# EAGLE board Resistor_Resistor (EAGLE 8.3.0), part 14 of 32
## Placement (x,y rotation side) (continued)
R16746  10K  [0201]  126.54,89.66 0 top
R16747  10K  [0201]  126.54,90.27 0 top
R16748  10K  [0201]  126.54,90.88 0 top
R16749  10K  [0201]  126.54,91.49 0 top
R16750  10K  [0201]  126.54,92.1 0 top
R16751  10K  [0201]  126.54,92.71 0 top
R16752  10K  [0201]  126.54,93.32 0 top
R16753  10K  [0201]  126.54,93.93 0 top
R16754  10K  [0201]  126.54,94.54 0 top
R16755  10K  [0201]  126.54,95.15 0 top
R16756  10K  [0201]  126.54,95.76 0 top
R16757  10K  [0201]  126.54,96.37 0 top
R16758  10K  [0201]  126.54,96.98 0 top
R16759  10K  [0201]  126.54,97.59 0 top
R16760  10K  [0201]  126.54,98.2 0 top
R16761  10K  [0201]  126.54,98.81 0 top
R16762  10K  [0201]  126.54,99.42 0 top
R16763  10K  [0201]  126.54,100.03 0 top
R16764  10K  [0201]  126.54,100.63 0 top
R16765  10K  [0201]  126.54,101.24 0 top
R16766  10K  [0201]  126.54,101.85 0 top
R16767  10K  [0201]  126.54,102.46 0 top
R16768  10K  [0201]  126.54,103.07 0 top
R16769  10K  [0201]  126.54,103.68 0 top
R16770  10K  [0201]  126.54,104.29 0 top
R16771  10K  [0201]  126.54,104.9 0 top
R16772  10K  [0201]  126.54,105.51 0 top
R16773  10K  [0201]  126.54,106.12 0 top
R16774  10K  [0201]  126.54,106.73 0 top
R16775  10K  [0201]  126.54,107.34 0 top
R16776  10K  [0201]  126.54,107.95 0 top
R16777  10K  [0201]  126.54,108.56 0 top
R16778  10K  [0201]  126.54,109.17 0 top
R16779  10K  [0201]  126.54,109.78 0 top
R16780  10K  [0201]  126.54,110.39 0 top
R16781  10K  [0201]  126.54,111 0 top
R16782  10K  [0201]  126.54,111.61 0 top
R16783  10K  [0201]  126.54,112.22 0 top
R16784  10K  [0201]  126.54,112.83 0 top
R16785  10K  [0201]  126.54,113.44 0 top
R16786  10K  [0201]  126.54,114.05 0 top
R16787  10K  [0201]  126.54,114.66 0 top
R16788  10K  [0201]  126.54,115.27 0 top
R16789  10K  [0201]  126.54,115.87 0 top
R16790  10K  [0201]  126.54,116.48 0 top
R16791  10K  [0201]  126.54,117.09 0 top
R16792  10K  [0201]  126.54,117.7 0 top
R16793  10K  [0201]  126.54,118.31 0 top
R16794  10K  [0201]  126.54,118.92 0 top
R16795  10K  [0201]  126.54,119.53 0 top
R16796  10K  [0201]  126.54,120.14 0 top
R16797  10K  [0201]  126.54,120.75 0 top
R16798  10K  [0201]  126.54,121.36 0 top
R16799  10K  [0201]  126.54,121.97 0 top
R16800  10K  [0201]  126.54,122.58 0 top
R16801  10K  [0201]  127.76,1.27 0 top
R16802  10K  [0201]  127.76,1.88 0 top
R16803  10K  [0201]  127.76,2.49 0 top
R16804  10K  [0201]  127.76,3.1 0 top
R16805  10K  [0201]  127.76,3.71 0 top
R16806  10K  [0201]  127.76,4.32 0 top
R16807  10K  [0201]  127.76,4.93 0 top
R16808  10K  [0201]  127.76,5.54 0 top
R16809  10K  [0201]  127.76,6.15 0 top
R16810  10K  [0201]  127.76,6.76 0 top
R16811  10K  [0201]  127.76,7.37 0 top
R16812  10K  [0201]  127.76,7.98 0 top
R16813  10K  [0201]  127.76,8.59 0 top
R16814  10K  [0201]  127.76,9.19 0 top
R16815  10K  [0201]  127.76,9.8 0 top
R16816  10K  [0201]  127.76,10.41 0 top
R16817  10K  [0201]  127.76,11.02 0 top
R16818  10K  [0201]  127.76,11.63 0 top
R16819  10K  [0201]  127.76,12.24 0 top
R16820  10K  [0201]  127.76,12.85 0 top
R16821  10K  [0201]  127.76,13.46 0 top
R16822  10K  [0201]  127.76,14.07 0 top
R16823  10K  [0201]  127.76,14.68 0 top
R16824  10K  [0201]  127.76,15.29 0 top
R16825  10K  [0201]  127.76,15.9 0 top
R16826  10K  [0201]  127.76,16.51 0 top
R16827  10K  [0201]  127.76,17.12 0 top
R16828  10K  [0201]  127.76,17.73 0 top
R16829  10K  [0201]  127.76,18.34 0 top
R16830  10K  [0201]  127.76,18.95 0 top
R16831  10K  [0201]  127.76,19.56 0 top
R16832  10K  [0201]  127.76,20.17 0 top
R16833  10K  [0201]  127.76,20.78 0 top
R16834  10K  [0201]  127.76,21.39 0 top
R16835  10K  [0201]  127.76,22 0 top
R16836  10K  [0201]  127.76,22.61 0 top
R16837  10K  [0201]  127.76,23.22 0 top
R16838  10K  [0201]  127.76,23.83 0 top
R16839  10K  [0201]  127.76,24.43 0 top
R16840  10K  [0201]  127.76,25.04 0 top
R16841  10K  [0201]  127.76,25.65 0 top
R16842  10K  [0201]  127.76,26.26 0 top
R16843  10K  [0201]  127.76,26.87 0 top
R16844  10K  [0201]  127.76,27.48 0 top
R16845  10K  [0201]  127.76,28.09 0 top
R16846  10K  [0201]  127.76,28.7 0 top
R16847  10K  [0201]  127.76,29.31 0 top
R16848  10K  [0201]  127.76,29.92 0 top
R16849  10K  [0201]  127.76,30.53 0 top
R16850  10K  [0201]  127.76,31.14 0 top
R16851  10K  [0201]  127.76,31.75 0 top
R16852  10K  [0201]  127.76,32.36 0 top
R16853  10K  [0201]  127.76,32.97 0 top
R16854  10K  [0201]  127.76,33.58 0 top
R16855  10K  [0201]  127.76,34.19 0 top
R16856  10K  [0201]  127.76,34.8 0 top
R16857  10K  [0201]  127.76,35.41 0 top
R16858  10K  [0201]  127.76,36.02 0 top
R16859  10K  [0201]  127.76,36.63 0 top
R16860  10K  [0201]  127.76,37.24 0 top
R16861  10K  [0201]  127.76,37.85 0 top
R16862  10K  [0201]  127.76,38.46 0 top
R16863  10K  [0201]  127.76,39.07 0 top
R16864  10K  [0201]  127.76,39.67 0 top
R16865  10K  [0201]  127.76,40.28 0 top
R16866  10K  [0201]  127.76,40.89 0 top
R16867  10K  [0201]  127.76,41.5 0 top
R16868  10K  [0201]  127.76,42.11 0 top
R16869  10K  [0201]  127.76,42.72 0 top
R16870  10K  [0201]  127.76,43.33 0 top
R16871  10K  [0201]  127.76,43.94 0 top
R16872  10K  [0201]  127.76,44.55 0 top
R16873  10K  [0201]  127.76,45.16 0 top
R16874  10K  [0201]  127.76,45.77 0 top
R16875  10K  [0201]  127.76,46.38 0 top
R16876  10K  [0201]  127.76,46.99 0 top
R16877  10K  [0201]  127.76,47.6 0 top
R16878  10K  [0201]  127.76,48.21 0 top
R16879  10K  [0201]  127.76,48.82 0 top
R16880  10K  [0201]  127.76,49.43 0 top
R16881  10K  [0201]  127.76,50.04 0 top
R16882  10K  [0201]  127.76,50.65 0 top
R16883  10K  [0201]  127.76,51.26 0 top
R16884  10K  [0201]  127.76,51.87 0 top
R16885  10K  [0201]  127.76,52.48 0 top
R16886  10K  [0201]  127.76,53.09 0 top
R16887  10K  [0201]  127.76,53.7 0 top
R16888  10K  [0201]  127.76,54.31 0 top
R16889  10K  [0201]  127.76,54.91 0 top
R16890  10K  [0201]  127.76,55.52 0 top
R16891  10K  [0201]  127.76,56.13 0 top
R16892  10K  [0201]  127.76,56.74 0 top
R16893  10K  [0201]  127.76,57.35 0 top
R16894  10K  [0201]  127.76,57.96 0 top
R16895  10K  [0201]  127.76,58.57 0 top
R16896  10K  [0201]  127.76,59.18 0 top
R16897  10K  [0201]  127.76,59.79 0 top
R16898  10K  [0201]  127.76,60.4 0 top
R16899  10K  [0201]  127.76,61.01 0 top
R16900  10K  [0201]  127.76,61.62 0 top
R16901  10K  [0201]  127.76,62.23 0 top
R16902  10K  [0201]  127.76,62.84 0 top
R16903  10K  [0201]  127.76,63.45 0 top
R16904  10K  [0201]  127.76,64.06 0 top
R16905  10K  [0201]  127.76,64.67 0 top
R16906  10K  [0201]  127.76,65.28 0 top
R16907  10K  [0201]  127.76,65.89 0 top
R16908  10K  [0201]  127.76,66.5 0 top
R16909  10K  [0201]  127.76,67.11 0 top
R16910  10K  [0201]  127.76,67.72 0 top
R16911  10K  [0201]  127.76,68.33 0 top
R16912  10K  [0201]  127.76,68.94 0 top
R16913  10K  [0201]  127.76,69.55 0 top
R16914  10K  [0201]  127.76,70.15 0 top
R16915  10K  [0201]  127.76,70.76 0 top
R16916  10K  [0201]  127.76,71.37 0 top
R16917  10K  [0201]  127.76,71.98 0 top
R16918  10K  [0201]  127.76,72.59 0 top
R16919  10K  [0201]  127.76,73.2 0 top
R16920  10K  [0201]  127.76,73.81 0 top
R16921  10K  [0201]  127.76,74.42 0 top
R16922  10K  [0201]  127.76,75.03 0 top
R16923  10K  [0201]  127.76,75.64 0 top
R16924  10K  [0201]  127.76,76.25 0 top
R16925  10K  [0201]  127.76,76.86 0 top
R16926  10K  [0201]  127.76,77.47 0 top
R16927  10K  [0201]  127.76,78.08 0 top
R16928  10K  [0201]  127.76,78.69 0 top
R16929  10K  [0201]  127.76,79.3 0 top
R16930  10K  [0201]  127.76,79.91 0 top
R16931  10K  [0201]  127.76,80.52 0 top
R16932  10K  [0201]  127.76,81.13 0 top
R16933  10K  [0201]  127.76,81.74 0 top
R16934  10K  [0201]  127.76,82.35 0 top
R16935  10K  [0201]  127.76,82.96 0 top
R16936  10K  [0201]  127.76,83.57 0 top
R16937  10K  [0201]  127.76,84.18 0 top
R16938  10K  [0201]  127.76,84.79 0 top
R16939  10K  [0201]  127.76,85.39 0 top
R16940  10K  [0201]  127.76,86 0 top
R16941  10K  [0201]  127.76,86.61 0 top
R16942  10K  [0201]  127.76,87.22 0 top
R16943  10K  [0201]  127.76,87.83 0 top
R16944  10K  [0201]  127.76,88.44 0 top
R16945  10K  [0201]  127.76,89.05 0 top
R16946  10K  [0201]  127.76,89.66 0 top
R16947  10K  [0201]  127.76,90.27 0 top
R16948  10K  [0201]  127.76,90.88 0 top
R16949  10K  [0201]  127.76,91.49 0 top
R16950  10K  [0201]  127.76,92.1 0 top
R16951  10K  [0201]  127.76,92.71 0 top
R16952  10K  [0201]  127.76,93.32 0 top
R16953  10K  [0201]  127.76,93.93 0 top
R16954  10K  [0201]  127.76,94.54 0 top
R16955  10K  [0201]  127.76,95.15 0 top
R16956  10K  [0201]  127.76,95.76 0 top
R16957  10K  [0201]  127.76,96.37 0 top
R16958  10K  [0201]  127.76,96.98 0 top
R16959  10K  [0201]  127.76,97.59 0 top
R16960  10K  [0201]  127.76,98.2 0 top
R16961  10K  [0201]  127.76,98.81 0 top
R16962  10K  [0201]  127.76,99.42 0 top
R16963  10K  [0201]  127.76,100.03 0 top
R16964  10K  [0201]  127.76,100.63 0 top
R16965  10K  [0201]  127.76,101.24 0 top
R16966  10K  [0201]  127.76,101.85 0 top
R16967  10K  [0201]  127.76,102.46 0 top
R16968  10K  [0201]  127.76,103.07 0 top
R16969  10K  [0201]  127.76,103.68 0 top
R16970  10K  [0201]  127.76,104.29 0 top
R16971  10K  [0201]  127.76,104.9 0 top
R16972  10K  [0201]  127.76,105.51 0 top
R16973  10K  [0201]  127.76,106.12 0 top
R16974  10K  [0201]  127.76,106.73 0 top
R16975  10K  [0201]  127.76,107.34 0 top
R16976  10K  [0201]  127.76,107.95 0 top
R16977  10K  [0201]  127.76,108.56 0 top
R16978  10K  [0201]  127.76,109.17 0 top
R16979  10K  [0201]  127.76,109.78 0 top
R16980  10K  [0201]  127.76,110.39 0 top
R16981  10K  [0201]  127.76,111 0 top
R16982  10K  [0201]  127.76,111.61 0 top
R16983  10K  [0201]  127.76,112.22 0 top
R16984  10K  [0201]  127.76,112.83 0 top
R16985  10K  [0201]  127.76,113.44 0 top
R16986  10K  [0201]  127.76,114.05 0 top
R16987  10K  [0201]  127.76,114.66 0 top
R16988  10K  [0201]  127.76,115.27 0 top
R16989  10K  [0201]  127.76,115.87 0 top
R16990  10K  [0201]  127.76,116.48 0 top
R16991  10K  [0201]  127.76,117.09 0 top
R16992  10K  [0201]  127.76,117.7 0 top
R16993  10K  [0201]  127.76,118.31 0 top
R16994  10K  [0201]  127.76,118.92 0 top
R16995  10K  [0201]  127.76,119.53 0 top
R16996  10K  [0201]  127.76,120.14 0 top
R16997  10K  [0201]  127.76,120.75 0 top
R16998  10K  [0201]  127.76,121.36 0 top
R16999  10K  [0201]  127.76,121.97 0 top
R17000  10K  [0201]  127.76,122.58 0 top
R17001  10K  [0201]  128.98,1.27 0 top
R17002  10K  [0201]  128.98,1.88 0 top
R17003  10K  [0201]  128.98,2.49 0 top
R17004  10K  [0201]  128.98,3.1 0 top
R17005  10K  [0201]  128.98,3.71 0 top
R17006  10K  [0201]  128.98,4.32 0 top
R17007  10K  [0201]  128.98,4.93 0 top
R17008  10K  [0201]  128.98,5.54 0 top
R17009  10K  [0201]  128.98,6.15 0 top
R17010  10K  [0201]  128.98,6.76 0 top
R17011  10K  [0201]  128.98,7.37 0 top
R17012  10K  [0201]  128.98,7.98 0 top
R17013  10K  [0201]  128.98,8.59 0 top
R17014  10K  [0201]  128.98,9.19 0 top
R17015  10K  [0201]  128.98,9.8 0 top
R17016  10K  [0201]  128.98,10.41 0 top
R17017  10K  [0201]  128.98,11.02 0 top
R17018  10K  [0201]  128.98,11.63 0 top
R17019  10K  [0201]  128.98,12.24 0 top
R17020  10K  [0201]  128.98,12.85 0 top
R17021  10K  [0201]  128.98,13.46 0 top
R17022  10K  [0201]  128.98,14.07 0 top
R17023  10K  [0201]  128.98,14.68 0 top
R17024  10K  [0201]  128.98,15.29 0 top
R17025  10K  [0201]  128.98,15.9 0 top
R17026  10K  [0201]  128.98,16.51 0 top
R17027  10K  [0201]  128.98,17.12 0 top
R17028  10K  [0201]  128.98,17.73 0 top
R17029  10K  [0201]  128.98,18.34 0 top
R17030  10K  [0201]  128.98,18.95 0 top
R17031  10K  [0201]  128.98,19.56 0 top
R17032  10K  [0201]  128.98,20.17 0 top
R17033  10K  [0201]  128.98,20.78 0 top
R17034  10K  [0201]  128.98,21.39 0 top
R17035  10K  [0201]  128.98,22 0 top
R17036  10K  [0201]  128.98,22.61 0 top
R17037  10K  [0201]  128.98,23.22 0 top
R17038  10K  [0201]  128.98,23.83 0 top
R17039  10K  [0201]  128.98,24.43 0 top
R17040  10K  [0201]  128.98,25.04 0 top
R17041  10K  [0201]  128.98,25.65 0 top
R17042  10K  [0201]  128.98,26.26 0 top
R17043  10K  [0201]  128.98,26.87 0 top
R17044  10K  [0201]  128.98,27.48 0 top
R17045  10K  [0201]  128.98,28.09 0 top
R17046  10K  [0201]  128.98,28.7 0 top
R17047  10K  [0201]  128.98,29.31 0 top
R17048  10K  [0201]  128.98,29.92 0 top
R17049  10K  [0201]  128.98,30.53 0 top
R17050  10K  [0201]  128.98,31.14 0 top
R17051  10K  [0201]  128.98,31.75 0 top
R17052  10K  [0201]  128.98,32.36 0 top
R17053  10K  [0201]  128.98,32.97 0 top
R17054  10K  [0201]  128.98,33.58 0 top
R17055  10K  [0201]  128.98,34.19 0 top
R17056  10K  [0201]  128.98,34.8 0 top
R17057  10K  [0201]  128.98,35.41 0 top
R17058  10K  [0201]  128.98,36.02 0 top
R17059  10K  [0201]  128.98,36.63 0 top
R17060  10K  [0201]  128.98,37.24 0 top
R17061  10K  [0201]  128.98,37.85 0 top
R17062  10K  [0201]  128.98,38.46 0 top
R17063  10K  [0201]  128.98,39.07 0 top
R17064  10K  [0201]  128.98,39.67 0 top
R17065  10K  [0201]  128.98,40.28 0 top
R17066  10K  [0201]  128.98,40.89 0 top
R17067  10K  [0201]  128.98,41.5 0 top
R17068  10K  [0201]  128.98,42.11 0 top
R17069  10K  [0201]  128.98,42.72 0 top
R17070  10K  [0201]  128.98,43.33 0 top
R17071  10K  [0201]  128.98,43.94 0 top
R17072  10K  [0201]  128.98,44.55 0 top
R17073  10K  [0201]  128.98,45.16 0 top
R17074  10K  [0201]  128.98,45.77 0 top
R17075  10K  [0201]  128.98,46.38 0 top
R17076  10K  [0201]  128.98,46.99 0 top
R17077  10K  [0201]  128.98,47.6 0 top
R17078  10K  [0201]  128.98,48.21 0 top
R17079  10K  [0201]  128.98,48.82 0 top
R17080  10K  [0201]  128.98,49.43 0 top
R17081  10K  [0201]  128.98,50.04 0 top
R17082  10K  [0201]  128.98,50.65 0 top
R17083  10K  [0201]  128.98,51.26 0 top
R17084  10K  [0201]  128.98,51.87 0 top
R17085  10K  [0201]  128.98,52.48 0 top
R17086  10K  [0201]  128.98,53.09 0 top
R17087  10K  [0201]  128.98,53.7 0 top
R17088  10K  [0201]  128.98,54.31 0 top
R17089  10K  [0201]  128.98,54.91 0 top
R17090  10K  [0201]  128.98,55.52 0 top
R17091  10K  [0201]  128.98,56.13 0 top
R17092  10K  [0201]  128.98,56.74 0 top
R17093  10K  [0201]  128.98,57.35 0 top
R17094  10K  [0201]  128.98,57.96 0 top
R17095  10K  [0201]  128.98,58.57 0 top
R17096  10K  [0201]  128.98,59.18 0 top
R17097  10K  [0201]  128.98,59.79 0 top
R17098  10K  [0201]  128.98,60.4 0 top
R17099  10K  [0201]  128.98,61.01 0 top
R17100  10K  [0201]  128.98,61.62 0 top
R17101  10K  [0201]  128.98,62.23 0 top
R17102  10K  [0201]  128.98,62.84 0 top
R17103  10K  [0201]  128.98,63.45 0 top
R17104  10K  [0201]  128.98,64.06 0 top
R17105  10K  [0201]  128.98,64.67 0 top
R17106  10K  [0201]  128.98,65.28 0 top
R17107  10K  [0201]  128.98,65.89 0 top
R17108  10K  [0201]  128.98,66.5 0 top
R17109  10K  [0201]  128.98,67.11 0 top
R17110  10K  [0201]  128.98,67.72 0 top
R17111  10K  [0201]  128.98,68.33 0 top
R17112  10K  [0201]  128.98,68.94 0 top
R17113  10K  [0201]  128.98,69.55 0 top
R17114  10K  [0201]  128.98,70.15 0 top
R17115  10K  [0201]  128.98,70.76 0 top
R17116  10K  [0201]  128.98,71.37 0 top
R17117  10K  [0201]  128.98,71.98 0 top
R17118  10K  [0201]  128.98,72.59 0 top
R17119  10K  [0201]  128.98,73.2 0 top
R17120  10K  [0201]  128.98,73.81 0 top
R17121  10K  [0201]  128.98,74.42 0 top
R17122  10K  [0201]  128.98,75.03 0 top
R17123  10K  [0201]  128.98,75.64 0 top
R17124  10K  [0201]  128.98,76.25 0 top
R17125  10K  [0201]  128.98,76.86 0 top
R17126  10K  [0201]  128.98,77.47 0 top
R17127  10K  [0201]  128.98,78.08 0 top
R17128  10K  [0201]  128.98,78.69 0 top
R17129  10K  [0201]  128.98,79.3 0 top
R17130  10K  [0201]  128.98,79.91 0 top
R17131  10K  [0201]  128.98,80.52 0 top
R17132  10K  [0201]  128.98,81.13 0 top
R17133  10K  [0201]  128.98,81.74 0 top
R17134  10K  [0201]  128.98,82.35 0 top
R17135  10K  [0201]  128.98,82.96 0 top
R17136  10K  [0201]  128.98,83.57 0 top
R17137  10K  [0201]  128.98,84.18 0 top
R17138  10K  [0201]  128.98,84.79 0 top
R17139  10K  [0201]  128.98,85.39 0 top
R17140  10K  [0201]  128.98,86 0 top
R17141  10K  [0201]  128.98,86.61 0 top
R17142  10K  [0201]  128.98,87.22 0 top
R17143  10K  [0201]  128.98,87.83 0 top
R17144  10K  [0201]  128.98,88.44 0 top
R17145  10K  [0201]  128.98,89.05 0 top
R17146  10K  [0201]  128.98,89.66 0 top
R17147  10K  [0201]  128.98,90.27 0 top
R17148  10K  [0201]  128.98,90.88 0 top
R17149  10K  [0201]  128.98,91.49 0 top
R17150  10K  [0201]  128.98,92.1 0 top
R17151  10K  [0201]  128.98,92.71 0 top
R17152  10K  [0201]  128.98,93.32 0 top
R17153  10K  [0201]  128.98,93.93 0 top
R17154  10K  [0201]  128.98,94.54 0 top
R17155  10K  [0201]  128.98,95.15 0 top
R17156  10K  [0201]  128.98,95.76 0 top
R17157  10K  [0201]  128.98,96.37 0 top
R17158  10K  [0201]  128.98,96.98 0 top
R17159  10K  [0201]  128.98,97.59 0 top
R17160  10K  [0201]  128.98,98.2 0 top
R17161  10K  [0201]  128.98,98.81 0 top
R17162  10K  [0201]  128.98,99.42 0 top
R17163  10K  [0201]  128.98,100.03 0 top
R17164  10K  [0201]  128.98,100.63 0 top
R17165  10K  [0201]  128.98,101.24 0 top
R17166  10K  [0201]  128.98,101.85 0 top
R17167  10K  [0201]  128.98,102.46 0 top
R17168  10K  [0201]  128.98,103.07 0 top
R17169  10K  [0201]  128.98,103.68 0 top
R17170  10K  [0201]  128.98,104.29 0 top
R17171  10K  [0201]  128.98,104.9 0 top
R17172  10K  [0201]  128.98,105.51 0 top
R17173  10K  [0201]  128.98,106.12 0 top
R17174  10K  [0201]  128.98,106.73 0 top
R17175  10K  [0201]  128.98,107.34 0 top
R17176  10K  [0201]  128.98,107.95 0 top
R17177  10K  [0201]  128.98,108.56 0 top
R17178  10K  [0201]  128.98,109.17 0 top
R17179  10K  [0201]  128.98,109.78 0 top
R17180  10K  [0201]  128.98,110.39 0 top
R17181  10K  [0201]  128.98,111 0 top
R17182  10K  [0201]  128.98,111.61 0 top
R17183  10K  [0201]  128.98,112.22 0 top
R17184  10K  [0201]  128.98,112.83 0 top
R17185  10K  [0201]  128.98,113.44 0 top
R17186  10K  [0201]  128.98,114.05 0 top
R17187  10K  [0201]  128.98,114.66 0 top
R17188  10K  [0201]  128.98,115.27 0 top
R17189  10K  [0201]  128.98,115.87 0 top
R17190  10K  [0201]  128.98,116.48 0 top
R17191  10K  [0201]  128.98,117.09 0 top
R17192  10K  [0201]  128.98,117.7 0 top
R17193  10K  [0201]  128.98,118.31 0 top
R17194  10K  [0201]  128.98,118.92 0 top
R17195  10K  [0201]  128.98,119.53 0 top
R17196  10K  [0201]  128.98,120.14 0 top
R17197  10K  [0201]  128.98,120.75 0 top
R17198  10K  [0201]  128.98,121.36 0 top
R17199  10K  [0201]  128.98,121.97 0 top
R17200  10K  [0201]  128.98,122.58 0 top
R17201  10K  [0201]  130.2,1.27 0 top
R17202  10K  [0201]  130.2,1.88 0 top
R17203  10K  [0201]  130.2,2.49 0 top
R17204  10K  [0201]  130.2,3.1 0 top
R17205  10K  [0201]  130.2,3.71 0 top
R17206  10K  [0201]  130.2,4.32 0 top
R17207  10K  [0201]  130.2,4.93 0 top
R17208  10K  [0201]  130.2,5.54 0 top
R17209  10K  [0201]  130.2,6.15 0 top
R17210  10K  [0201]  130.2,6.76 0 top
R17211  10K  [0201]  130.2,7.37 0 top
R17212  10K  [0201]  130.2,7.98 0 top
R17213  10K  [0201]  130.2,8.59 0 top
R17214  10K  [0201]  130.2,9.19 0 top
R17215  10K  [0201]  130.2,9.8 0 top
R17216  10K  [0201]  130.2,10.41 0 top
R17217  10K  [0201]  130.2,11.02 0 top
R17218  10K  [0201]  130.2,11.63 0 top
R17219  10K  [0201]  130.2,12.24 0 top
R17220  10K  [0201]  130.2,12.85 0 top
R17221  10K  [0201]  130.2,13.46 0 top
R17222  10K  [0201]  130.2,14.07 0 top
R17223  10K  [0201]  130.2,14.68 0 top
R17224  10K  [0201]  130.2,15.29 0 top
R17225  10K  [0201]  130.2,15.9 0 top
R17226  10K  [0201]  130.2,16.51 0 top
R17227  10K  [0201]  130.2,17.12 0 top
R17228  10K  [0201]  130.2,17.73 0 top
R17229  10K  [0201]  130.2,18.34 0 top
R17230  10K  [0201]  130.2,18.95 0 top
R17231  10K  [0201]  130.2,19.56 0 top
R17232  10K  [0201]  130.2,20.17 0 top
R17233  10K  [0201]  130.2,20.78 0 top
R17234  10K  [0201]  130.2,21.39 0 top
R17235  10K  [0201]  130.2,22 0 top
R17236  10K  [0201]  130.2,22.61 0 top
R17237  10K  [0201]  130.2,23.22 0 top
R17238  10K  [0201]  130.2,23.83 0 top
R17239  10K  [0201]  130.2,24.43 0 top
R17240  10K  [0201]  130.2,25.04 0 top
R17241  10K  [0201]  130.2,25.65 0 top
R17242  10K  [0201]  130.2,26.26 0 top
R17243  10K  [0201]  130.2,26.87 0 top
R17244  10K  [0201]  130.2,27.48 0 top
R17245  10K  [0201]  130.2,28.09 0 top
R17246  10K  [0201]  130.2,28.7 0 top
R17247  10K  [0201]  130.2,29.31 0 top
R17248  10K  [0201]  130.2,29.92 0 top
R17249  10K  [0201]  130.2,30.53 0 top
R17250  10K  [0201]  130.2,31.14 0 top
R17251  10K  [0201]  130.2,31.75 0 top
R17252  10K  [0201]  130.2,32.36 0 top
R17253  10K  [0201]  130.2,32.97 0 top
R17254  10K  [0201]  130.2,33.58 0 top
R17255  10K  [0201]  130.2,34.19 0 top
R17256  10K  [0201]  130.2,34.8 0 top
R17257  10K  [0201]  130.2,35.41 0 top
R17258  10K  [0201]  130.2,36.02 0 top
R17259  10K  [0201]  130.2,36.63 0 top
R17260  10K  [0201]  130.2,37.24 0 top
R17261  10K  [0201]  130.2,37.85 0 top
R17262  10K  [0201]  130.2,38.46 0 top
R17263  10K  [0201]  130.2,39.07 0 top
R17264  10K  [0201]  130.2,39.67 0 top
R17265  10K  [0201]  130.2,40.28 0 top
R17266  10K  [0201]  130.2,40.89 0 top
R17267  10K  [0201]  130.2,41.5 0 top
R17268  10K  [0201]  130.2,42.11 0 top
R17269  10K  [0201]  130.2,42.72 0 top
R17270  10K  [0201]  130.2,43.33 0 top
R17271  10K  [0201]  130.2,43.94 0 top
R17272  10K  [0201]  130.2,44.55 0 top
R17273  10K  [0201]  130.2,45.16 0 top
R17274  10K  [0201]  130.2,45.77 0 top
R17275  10K  [0201]  130.2,46.38 0 top
R17276  10K  [0201]  130.2,46.99 0 top
R17277  10K  [0201]  130.2,47.6 0 top
R17278  10K  [0201]  130.2,48.21 0 top
R17279  10K  [0201]  130.2,48.82 0 top
R17280  10K  [0201]  130.2,49.43 0 top
R17281  10K  [0201]  130.2,50.04 0 top
R17282  10K  [0201]  130.2,50.65 0 top
R17283  10K  [0201]  130.2,51.26 0 top
R17284  10K  [0201]  130.2,51.87 0 top
R17285  10K  [0201]  130.2,52.48 0 top
R17286  10K  [0201]  130.2,53.09 0 top
R17287  10K  [0201]  130.2,53.7 0 top
R17288  10K  [0201]  130.2,54.31 0 top
R17289  10K  [0201]  130.2,54.91 0 top
R17290  10K  [0201]  130.2,55.52 0 top
R17291  10K  [0201]  130.2,56.13 0 top
R17292  10K  [0201]  130.2,56.74 0 top
R17293  10K  [0201]  130.2,57.35 0 top
R17294  10K  [0201]  130.2,57.96 0 top
R17295  10K  [0201]  130.2,58.57 0 top
R17296  10K  [0201]  130.2,59.18 0 top
R17297  10K  [0201]  130.2,59.79 0 top
R17298  10K  [0201]  130.2,60.4 0 top
R17299  10K  [0201]  130.2,61.01 0 top
R17300  10K  [0201]  130.2,61.62 0 top
R17301  10K  [0201]  130.2,62.23 0 top
R17302  10K  [0201]  130.2,62.84 0 top
R17303  10K  [0201]  130.2,63.45 0 top
R17304  10K  [0201]  130.2,64.06 0 top
R17305  10K  [0201]  130.2,64.67 0 top
R17306  10K  [0201]  130.2,65.28 0 top
R17307  10K  [0201]  130.2,65.89 0 top
R17308  10K  [0201]  130.2,66.5 0 top
R17309  10K  [0201]  130.2,67.11 0 top
R17310  10K  [0201]  130.2,67.72 0 top
R17311  10K  [0201]  130.2,68.33 0 top
R17312  10K  [0201]  130.2,68.94 0 top
R17313  10K  [0201]  130.2,69.55 0 top
R17314  10K  [0201]  130.2,70.15 0 top
R17315  10K  [0201]  130.2,70.76 0 top
R17316  10K  [0201]  130.2,71.37 0 top
R17317  10K  [0201]  130.2,71.98 0 top
R17318  10K  [0201]  130.2,72.59 0 top
R17319  10K  [0201]  130.2,73.2 0 top
R17320  10K  [0201]  130.2,73.81 0 top
R17321  10K  [0201]  130.2,74.42 0 top
R17322  10K  [0201]  130.2,75.03 0 top
R17323  10K  [0201]  130.2,75.64 0 top
R17324  10K  [0201]  130.2,76.25 0 top
R17325  10K  [0201]  130.2,76.86 0 top
R17326  10K  [0201]  130.2,77.47 0 top
R17327  10K  [0201]  130.2,78.08 0 top
R17328  10K  [0201]  130.2,78.69 0 top
R17329  10K  [0201]  130.2,79.3 0 top
R17330  10K  [0201]  130.2,79.91 0 top
R17331  10K  [0201]  130.2,80.52 0 top
R17332  10K  [0201]  130.2,81.13 0 top
R17333  10K  [0201]  130.2,81.74 0 top
R17334  10K  [0201]  130.2,82.35 0 top
R17335  10K  [0201]  130.2,82.96 0 top
R17336  10K  [0201]  130.2,83.57 0 top
R17337  10K  [0201]  130.2,84.18 0 top
R17338  10K  [0201]  130.2,84.79 0 top
R17339  10K  [0201]  130.2,85.39 0 top
R17340  10K  [0201]  130.2,86 0 top
R17341  10K  [0201]  130.2,86.61 0 top
R17342  10K  [0201]  130.2,87.22 0 top
R17343  10K  [0201]  130.2,87.83 0 top
R17344  10K  [0201]  130.2,88.44 0 top
R17345  10K  [0201]  130.2,89.05 0 top
R17346  10K  [0201]  130.2,89.66 0 top
R17347  10K  [0201]  130.2,90.27 0 top
R17348  10K  [0201]  130.2,90.88 0 top
R17349  10K  [0201]  130.2,91.49 0 top
R17350  10K  [0201]  130.2,92.1 0 top
R17351  10K  [0201]  130.2,92.71 0 top
R17352  10K  [0201]  130.2,93.32 0 top
R17353  10K  [0201]  130.2,93.93 0 top
R17354  10K  [0201]  130.2,94.54 0 top
R17355  10K  [0201]  130.2,95.15 0 top
R17356  10K  [0201]  130.2,95.76 0 top
R17357  10K  [0201]  130.2,96.37 0 top
R17358  10K  [0201]  130.2,96.98 0 top
R17359  10K  [0201]  130.2,97.59 0 top
R17360  10K  [0201]  130.2,98.2 0 top
R17361  10K  [0201]  130.2,98.81 0 top
R17362  10K  [0201]  130.2,99.42 0 top
R17363  10K  [0201]  130.2,100.03 0 top
R17364  10K  [0201]  130.2,100.63 0 top
R17365  10K  [0201]  130.2,101.24 0 top
R17366  10K  [0201]  130.2,101.85 0 top
R17367  10K  [0201]  130.2,102.46 0 top
R17368  10K  [0201]  130.2,103.07 0 top
R17369  10K  [0201]  130.2,103.68 0 top
R17370  10K  [0201]  130.2,104.29 0 top
R17371  10K  [0201]  130.2,104.9 0 top
R17372  10K  [0201]  130.2,105.51 0 top
R17373  10K  [0201]  130.2,106.12 0 top
R17374  10K  [0201]  130.2,106.73 0 top
R17375  10K  [0201]  130.2,107.34 0 top
R17376  10K  [0201]  130.2,107.95 0 top
R17377  10K  [0201]  130.2,108.56 0 top
R17378  10K  [0201]  130.2,109.17 0 top
R17379  10K  [0201]  130.2,109.78 0 top
R17380  10K  [0201]  130.2,110.39 0 top
R17381  10K  [0201]  130.2,111 0 top
R17382  10K  [0201]  130.2,111.61 0 top
R17383  10K  [0201]  130.2,112.22 0 top
R17384  10K  [0201]  130.2,112.83 0 top
R17385  10K  [0201]  130.2,113.44 0 top
R17386  10K  [0201]  130.2,114.05 0 top
R17387  10K  [0201]  130.2,114.66 0 top
R17388  10K  [0201]  130.2,115.27 0 top
R17389  10K  [0201]  130.2,115.87 0 top
R17390  10K  [0201]  130.2,116.48 0 top
R17391  10K  [0201]  130.2,117.09 0 top
R17392  10K  [0201]  130.2,117.7 0 top
R17393  10K  [0201]  130.2,118.31 0 top
R17394  10K  [0201]  130.2,118.92 0 top
R17395  10K  [0201]  130.2,119.53 0 top
R17396  10K  [0201]  130.2,120.14 0 top
R17397  10K  [0201]  130.2,120.75 0 top
R17398  10K  [0201]  130.2,121.36 0 top
R17399  10K  [0201]  130.2,121.97 0 top
R17400  10K  [0201]  130.2,122.58 0 top
R17401  10K  [0201]  131.42,1.27 0 top
R17402  10K  [0201]  131.42,1.88 0 top
R17403  10K  [0201]  131.42,2.49 0 top
R17404  10K  [0201]  131.42,3.1 0 top
R17405  10K  [0201]  131.42,3.71 0 top
R17406  10K  [0201]  131.42,4.32 0 top
R17407  10K  [0201]  131.42,4.93 0 top
R17408  10K  [0201]  131.42,5.54 0 top
R17409  10K  [0201]  131.42,6.15 0 top
R17410  10K  [0201]  131.42,6.76 0 top
R17411  10K  [0201]  131.42,7.37 0 top
R17412  10K  [0201]  131.42,7.98 0 top
R17413  10K  [0201]  131.42,8.59 0 top
R17414  10K  [0201]  131.42,9.19 0 top
R17415  10K  [0201]  131.42,9.8 0 top
R17416  10K  [0201]  131.42,10.41 0 top
R17417  10K  [0201]  131.42,11.02 0 top
R17418  10K  [0201]  131.42,11.63 0 top
R17419  10K  [0201]  131.42,12.24 0 top
R17420  10K  [0201]  131.42,12.85 0 top
R17421  10K  [0201]  131.42,13.46 0 top
R17422  10K  [0201]  131.42,14.07 0 top
R17423  10K  [0201]  131.42,14.68 0 top
R17424  10K  [0201]  131.42,15.29 0 top
R17425  10K  [0201]  131.42,15.9 0 top
R17426  10K  [0201]  131.42,16.51 0 top
R17427  10K  [0201]  131.42,17.12 0 top
R17428  10K  [0201]  131.42,17.73 0 top
R17429  10K  [0201]  131.42,18.34 0 top
R17430  10K  [0201]  131.42,18.95 0 top
R17431  10K  [0201]  131.42,19.56 0 top
R17432  10K  [0201]  131.42,20.17 0 top
R17433  10K  [0201]  131.42,20.78 0 top
R17434  10K  [0201]  131.42,21.39 0 top
R17435  10K  [0201]  131.42,22 0 top
R17436  10K  [0201]  131.42,22.61 0 top
R17437  10K  [0201]  131.42,23.22 0 top
R17438  10K  [0201]  131.42,23.83 0 top
R17439  10K  [0201]  131.42,24.43 0 top
R17440  10K  [0201]  131.42,25.04 0 top
R17441  10K  [0201]  131.42,25.65 0 top
R17442  10K  [0201]  131.42,26.26 0 top
R17443  10K  [0201]  131.42,26.87 0 top
R17444  10K  [0201]  131.42,27.48 0 top
R17445  10K  [0201]  131.42,28.09 0 top
R17446  10K  [0201]  131.42,28.7 0 top
R17447  10K  [0201]  131.42,29.31 0 top
R17448  10K  [0201]  131.42,29.92 0 top
R17449  10K  [0201]  131.42,30.53 0 top
R17450  10K  [0201]  131.42,31.14 0 top
R17451  10K  [0201]  131.42,31.75 0 top
R17452  10K  [0201]  131.42,32.36 0 top
R17453  10K  [0201]  131.42,32.97 0 top
R17454  10K  [0201]  131.42,33.58 0 top
R17455  10K  [0201]  131.42,34.19 0 top
R17456  10K  [0201]  131.42,34.8 0 top
R17457  10K  [0201]  131.42,35.41 0 top
R17458  10K  [0201]  131.42,36.02 0 top
R17459  10K  [0201]  131.42,36.63 0 top
R17460  10K  [0201]  131.42,37.24 0 top
R17461  10K  [0201]  131.42,37.85 0 top
R17462  10K  [0201]  131.42,38.46 0 top
R17463  10K  [0201]  131.42,39.07 0 top
R17464  10K  [0201]  131.42,39.67 0 top
R17465  10K  [0201]  131.42,40.28 0 top
R17466  10K  [0201]  131.42,40.89 0 top
R17467  10K  [0201]  131.42,41.5 0 top
R17468  10K  [0201]  131.42,42.11 0 top
R17469  10K  [0201]  131.42,42.72 0 top
R17470  10K  [0201]  131.42,43.33 0 top
R17471  10K  [0201]  131.42,43.94 0 top
R17472  10K  [0201]  131.42,44.55 0 top
R17473  10K  [0201]  131.42,45.16 0 top
R17474  10K  [0201]  131.42,45.77 0 top
R17475  10K  [0201]  131.42,46.38 0 top
R17476  10K  [0201]  131.42,46.99 0 top
R17477  10K  [0201]  131.42,47.6 0 top
R17478  10K  [0201]  131.42,48.21 0 top
R17479  10K  [0201]  131.42,48.82 0 top
R17480  10K  [0201]  131.42,49.43 0 top
R17481  10K  [0201]  131.42,50.04 0 top
R17482  10K  [0201]  131.42,50.65 0 top
R17483  10K  [0201]  131.42,51.26 0 top
R17484  10K  [0201]  131.42,51.87 0 top
R17485  10K  [0201]  131.42,52.48 0 top
R17486  10K  [0201]  131.42,53.09 0 top
R17487  10K  [0201]  131.42,53.7 0 top
R17488  10K  [0201]  131.42,54.31 0 top
R17489  10K  [0201]  131.42,54.91 0 top
R17490  10K  [0201]  131.42,55.52 0 top
R17491  10K  [0201]  131.42,56.13 0 top
R17492  10K  [0201]  131.42,56.74 0 top
R17493  10K  [0201]  131.42,57.35 0 top
R17494  10K  [0201]  131.42,57.96 0 top
R17495  10K  [0201]  131.42,58.57 0 top
R17496  10K  [0201]  131.42,59.18 0 top
R17497  10K  [0201]  131.42,59.79 0 top
R17498  10K  [0201]  131.42,60.4 0 top
R17499  10K  [0201]  131.42,61.01 0 top
R17500  10K  [0201]  131.42,61.62 0 top
R17501  10K  [0201]  131.42,62.23 0 top
R17502  10K  [0201]  131.42,62.84 0 top
R17503  10K  [0201]  131.42,63.45 0 top
R17504  10K  [0201]  131.42,64.06 0 top
R17505  10K  [0201]  131.42,64.67 0 top
R17506  10K  [0201]  131.42,65.28 0 top
R17507  10K  [0201]  131.42,65.89 0 top
R17508  10K  [0201]  131.42,66.5 0 top
R17509  10K  [0201]  131.42,67.11 0 top
R17510  10K  [0201]  131.42,67.72 0 top
R17511  10K  [0201]  131.42,68.33 0 top
R17512  10K  [0201]  131.42,68.94 0 top
R17513  10K  [0201]  131.42,69.55 0 top
R17514  10K  [0201]  131.42,70.15 0 top
R17515  10K  [0201]  131.42,70.76 0 top
R17516  10K  [0201]  131.42,71.37 0 top
R17517  10K  [0201]  131.42,71.98 0 top
R17518  10K  [0201]  131.42,72.59 0 top
R17519  10K  [0201]  131.42,73.2 0 top
R17520  10K  [0201]  131.42,73.81 0 top
R17521  10K  [0201]  131.42,74.42 0 top
R17522  10K  [0201]  131.42,75.03 0 top
R17523  10K  [0201]  131.42,75.64 0 top
R17524  10K  [0201]  131.42,76.25 0 top
R17525  10K  [0201]  131.42,76.86 0 top
R17526  10K  [0201]  131.42,77.47 0 top
R17527  10K  [0201]  131.42,78.08 0 top
R17528  10K  [0201]  131.42,78.69 0 top
R17529  10K  [0201]  131.42,79.3 0 top
R17530  10K  [0201]  131.42,79.91 0 top
R17531  10K  [0201]  131.42,80.52 0 top
R17532  10K  [0201]  131.42,81.13 0 top
R17533  10K  [0201]  131.42,81.74 0 top
R17534  10K  [0201]  131.42,82.35 0 top
R17535  10K  [0201]  131.42,82.96 0 top
R17536  10K  [0201]  131.42,83.57 0 top
R17537  10K  [0201]  131.42,84.18 0 top
R17538  10K  [0201]  131.42,84.79 0 top
R17539  10K  [0201]  131.42,85.39 0 top
R17540  10K  [0201]  131.42,86 0 top
R17541  10K  [0201]  131.42,86.61 0 top
R17542  10K  [0201]  131.42,87.22 0 top
R17543  10K  [0201]  131.42,87.83 0 top
R17544  10K  [0201]  131.42,88.44 0 top
R17545  10K  [0201]  131.42,89.05 0 top
R17546  10K  [0201]  131.42,89.66 0 top
R17547  10K  [0201]  131.42,90.27 0 top
R17548  10K  [0201]  131.42,90.88 0 top
R17549  10K  [0201]  131.42,91.49 0 top
R17550  10K  [0201]  131.42,92.1 0 top
R17551  10K  [0201]  131.42,92.71 0 top
R17552  10K  [0201]  131.42,93.32 0 top
R17553  10K  [0201]  131.42,93.93 0 top
R17554  10K  [0201]  131.42,94.54 0 top
R17555  10K  [0201]  131.42,95.15 0 top
R17556  10K  [0201]  131.42,95.76 0 top
R17557  10K  [0201]  131.42,96.37 0 top
R17558  10K  [0201]  131.42,96.98 0 top
R17559  10K  [0201]  131.42,97.59 0 top
R17560  10K  [0201]  131.42,98.2 0 top
R17561  10K  [0201]  131.42,98.81 0 top
R17562  10K  [0201]  131.42,99.42 0 top
R17563  10K  [0201]  131.42,100.03 0 top
R17564  10K  [0201]  131.42,100.63 0 top
R17565  10K  [0201]  131.42,101.24 0 top
R17566  10K  [0201]  131.42,101.85 0 top
R17567  10K  [0201]  131.42,102.46 0 top
R17568  10K  [0201]  131.42,103.07 0 top
R17569  10K  [0201]  131.42,103.68 0 top
R17570  10K  [0201]  131.42,104.29 0 top
R17571  10K  [0201]  131.42,104.9 0 top
R17572  10K  [0201]  131.42,105.51 0 top
R17573  10K  [0201]  131.42,106.12 0 top
R17574  10K  [0201]  131.42,106.73 0 top
R17575  10K  [0201]  131.42,107.34 0 top
R17576  10K  [0201]  131.42,107.95 0 top
R17577  10K  [0201]  131.42,108.56 0 top
R17578  10K  [0201]  131.42,109.17 0 top
R17579  10K  [0201]  131.42,109.78 0 top
R17580  10K  [0201]  131.42,110.39 0 top
R17581  10K  [0201]  131.42,111 0 top
R17582  10K  [0201]  131.42,111.61 0 top
R17583  10K  [0201]  131.42,112.22 0 top
R17584  10K  [0201]  131.42,112.83 0 top
R17585  10K  [0201]  131.42,113.44 0 top
R17586  10K  [0201]  131.42,114.05 0 top
R17587  10K  [0201]  131.42,114.66 0 top
R17588  10K  [0201]  131.42,115.27 0 top
R17589  10K  [0201]  131.42,115.87 0 top
R17590  10K  [0201]  131.42,116.48 0 top
R17591  10K  [0201]  131.42,117.09 0 top
R17592  10K  [0201]  131.42,117.7 0 top
R17593  10K  [0201]  131.42,118.31 0 top
R17594  10K  [0201]  131.42,118.92 0 top
R17595  10K  [0201]  131.42,119.53 0 top
R17596  10K  [0201]  131.42,120.14 0 top
R17597  10K  [0201]  131.42,120.75 0 top
R17598  10K  [0201]  131.42,121.36 0 top
R17599  10K  [0201]  131.42,121.97 0 top
R17600  10K  [0201]  131.42,122.58 0 top
R17601  10K  [0201]  132.64,1.27 0 top
R17602  10K  [0201]  132.64,1.88 0 top
R17603  10K  [0201]  132.64,2.49 0 top
R17604  10K  [0201]  132.64,3.1 0 top
R17605  10K  [0201]  132.64,3.71 0 top
R17606  10K  [0201]  132.64,4.32 0 top
R17607  10K  [0201]  132.64,4.93 0 top
R17608  10K  [0201]  132.64,5.54 0 top
R17609  10K  [0201]  132.64,6.15 0 top
R17610  10K  [0201]  132.64,6.76 0 top
R17611  10K  [0201]  132.64,7.37 0 top
R17612  10K  [0201]  132.64,7.98 0 top
R17613  10K  [0201]  132.64,8.59 0 top
R17614  10K  [0201]  132.64,9.19 0 top
R17615  10K  [0201]  132.64,9.8 0 top
R17616  10K  [0201]  132.64,10.41 0 top
R17617  10K  [0201]  132.64,11.02 0 top
R17618  10K  [0201]  132.64,11.63 0 top
R17619  10K  [0201]  132.64,12.24 0 top
R17620  10K  [0201]  132.64,12.85 0 top
R17621  10K  [0201]  132.64,13.46 0 top
R17622  10K  [0201]  132.64,14.07 0 top
R17623  10K  [0201]  132.64,14.68 0 top
R17624  10K  [0201]  132.64,15.29 0 top
R17625  10K  [0201]  132.64,15.9 0 top
R17626  10K  [0201]  132.64,16.51 0 top
R17627  10K  [0201]  132.64,17.12 0 top
R17628  10K  [0201]  132.64,17.73 0 top
R17629  10K  [0201]  132.64,18.34 0 top
R17630  10K  [0201]  132.64,18.95 0 top
R17631  10K  [0201]  132.64,19.56 0 top
R17632  10K  [0201]  132.64,20.17 0 top
R17633  10K  [0201]  132.64,20.78 0 top
R17634  10K  [0201]  132.64,21.39 0 top
R17635  10K  [0201]  132.64,22 0 top
R17636  10K  [0201]  132.64,22.61 0 top
R17637  10K  [0201]  132.64,23.22 0 top
R17638  10K  [0201]  132.64,23.83 0 top
R17639  10K  [0201]  132.64,24.43 0 top
R17640  10K  [0201]  132.64,25.04 0 top
R17641  10K  [0201]  132.64,25.65 0 top
R17642  10K  [0201]  132.64,26.26 0 top
R17643  10K  [0201]  132.64,26.87 0 top
R17644  10K  [0201]  132.64,27.48 0 top
R17645  10K  [0201]  132.64,28.09 0 top
R17646  10K  [0201]  132.64,28.7 0 top
R17647  10K  [0201]  132.64,29.31 0 top
R17648  10K  [0201]  132.64,29.92 0 top
R17649  10K  [0201]  132.64,30.53 0 top
R17650  10K  [0201]  132.64,31.14 0 top
R17651  10K  [0201]  132.64,31.75 0 top
R17652  10K  [0201]  132.64,32.36 0 top
R17653  10K  [0201]  132.64,32.97 0 top
R17654  10K  [0201]  132.64,33.58 0 top
R17655  10K  [0201]  132.64,34.19 0 top
R17656  10K  [0201]  132.64,34.8 0 top
R17657  10K  [0201]  132.64,35.41 0 top
R17658  10K  [0201]  132.64,36.02 0 top
R17659  10K  [0201]  132.64,36.63 0 top
R17660  10K  [0201]  132.64,37.24 0 top
R17661  10K  [0201]  132.64,37.85 0 top
R17662  10K  [0201]  132.64,38.46 0 top
R17663  10K  [0201]  132.64,39.07 0 top
R17664  10K  [0201]  132.64,39.67 0 top
R17665  10K  [0201]  132.64,40.28 0 top
R17666  10K  [0201]  132.64,40.89 0 top
R17667  10K  [0201]  132.64,41.5 0 top
R17668  10K  [0201]  132.64,42.11 0 top
R17669  10K  [0201]  132.64,42.72 0 top
R17670  10K  [0201]  132.64,43.33 0 top
R17671  10K  [0201]  132.64,43.94 0 top
R17672  10K  [0201]  132.64,44.55 0 top
R17673  10K  [0201]  132.64,45.16 0 top
R17674  10K  [0201]  132.64,45.77 0 top
R17675  10K  [0201]  132.64,46.38 0 top
R17676  10K  [0201]  132.64,46.99 0 top
R17677  10K  [0201]  132.64,47.6 0 top
R17678  10K  [0201]  132.64,48.21 0 top
R17679  10K  [0201]  132.64,48.82 0 top
R17680  10K  [0201]  132.64,49.43 0 top
R17681  10K  [0201]  132.64,50.04 0 top
R17682  10K  [0201]  132.64,50.65 0 top
R17683  10K  [0201]  132.64,51.26 0 top
R17684  10K  [0201]  132.64,51.87 0 top
R17685  10K  [0201]  132.64,52.48 0 top
R17686  10K  [0201]  132.64,53.09 0 top
R17687  10K  [0201]  132.64,53.7 0 top
R17688  10K  [0201]  132.64,54.31 0 top
R17689  10K  [0201]  132.64,54.91 0 top
R17690  10K  [0201]  132.64,55.52 0 top
R17691  10K  [0201]  132.64,56.13 0 top
R17692  10K  [0201]  132.64,56.74 0 top
R17693  10K  [0201]  132.64,57.35 0 top
R17694  10K  [0201]  132.64,57.96 0 top
R17695  10K  [0201]  132.64,58.57 0 top
R17696  10K  [0201]  132.64,59.18 0 top
R17697  10K  [0201]  132.64,59.79 0 top
R17698  10K  [0201]  132.64,60.4 0 top
R17699  10K  [0201]  132.64,61.01 0 top
R17700  10K  [0201]  132.64,61.62 0 top
R17701  10K  [0201]  132.64,62.23 0 top
R17702  10K  [0201]  132.64,62.84 0 top
R17703  10K  [0201]  132.64,63.45 0 top
R17704  10K  [0201]  132.64,64.06 0 top
R17705  10K  [0201]  132.64,64.67 0 top
R17706  10K  [0201]  132.64,65.28 0 top
R17707  10K  [0201]  132.64,65.89 0 top
R17708  10K  [0201]  132.64,66.5 0 top
R17709  10K  [0201]  132.64,67.11 0 top
R17710  10K  [0201]  132.64,67.72 0 top
R17711  10K  [0201]  132.64,68.33 0 top
R17712  10K  [0201]  132.64,68.94 0 top
R17713  10K  [0201]  132.64,69.55 0 top
R17714  10K  [0201]  132.64,70.15 0 top
R17715  10K  [0201]  132.64,70.76 0 top
R17716  10K  [0201]  132.64,71.37 0 top
R17717  10K  [0201]  132.64,71.98 0 top
R17718  10K  [0201]  132.64,72.59 0 top
R17719  10K  [0201]  132.64,73.2 0 top
R17720  10K  [0201]  132.64,73.81 0 top
R17721  10K  [0201]  132.64,74.42 0 top
R17722  10K  [0201]  132.64,75.03 0 top
R17723  10K  [0201]  132.64,75.64 0 top
R17724  10K  [0201]  132.64,76.25 0 top
R17725  10K  [0201]  132.64,76.86 0 top
R17726  10K  [0201]  132.64,77.47 0 top
R17727  10K  [0201]  132.64,78.08 0 top
R17728  10K  [0201]  132.64,78.69 0 top
R17729  10K  [0201]  132.64,79.3 0 top
R17730  10K  [0201]  132.64,79.91 0 top
R17731  10K  [0201]  132.64,80.52 0 top
R17732  10K  [0201]  132.64,81.13 0 top
R17733  10K  [0201]  132.64,81.74 0 top
R17734  10K  [0201]  132.64,82.35 0 top
R17735  10K  [0201]  132.64,82.96 0 top
R17736  10K  [0201]  132.64,83.57 0 top
R17737  10K  [0201]  132.64,84.18 0 top
R17738  10K  [0201]  132.64,84.79 0 top
R17739  10K  [0201]  132.64,85.39 0 top
R17740  10K  [0201]  132.64,86 0 top
R17741  10K  [0201]  132.64,86.61 0 top
R17742  10K  [0201]  132.64,87.22 0 top
R17743  10K  [0201]  132.64,87.83 0 top
R17744  10K  [0201]  132.64,88.44 0 top
R17745  10K  [0201]  132.64,89.05 0 top
R17746  10K  [0201]  132.64,89.66 0 top
R17747  10K  [0201]  132.64,90.27 0 top
R17748  10K  [0201]  132.64,90.88 0 top
R17749  10K  [0201]  132.64,91.49 0 top
R17750  10K  [0201]  132.64,92.1 0 top
R17751  10K  [0201]  132.64,92.71 0 top
R17752  10K  [0201]  132.64,93.32 0 top
R17753  10K  [0201]  132.64,93.93 0 top
R17754  10K  [0201]  132.64,94.54 0 top
R17755  10K  [0201]  132.64,95.15 0 top
R17756  10K  [0201]  132.64,95.76 0 top
R17757  10K  [0201]  132.64,96.37 0 top
R17758  10K  [0201]  132.64,96.98 0 top
R17759  10K  [0201]  132.64,97.59 0 top
R17760  10K  [0201]  132.64,98.2 0 top
R17761  10K  [0201]  132.64,98.81 0 top
R17762  10K  [0201]  132.64,99.42 0 top
R17763  10K  [0201]  132.64,100.03 0 top
R17764  10K  [0201]  132.64,100.63 0 top
R17765  10K  [0201]  132.64,101.24 0 top
R17766  10K  [0201]  132.64,101.85 0 top
R17767  10K  [0201]  132.64,102.46 0 top
R17768  10K  [0201]  132.64,103.07 0 top
R17769  10K  [0201]  132.64,103.68 0 top
R17770  10K  [0201]  132.64,104.29 0 top
R17771  10K  [0201]  132.64,104.9 0 top
R17772  10K  [0201]  132.64,105.51 0 top
R17773  10K  [0201]  132.64,106.12 0 top
R17774  10K  [0201]  132.64,106.73 0 top
R17775  10K  [0201]  132.64,107.34 0 top
R17776  10K  [0201]  132.64,107.95 0 top
R17777  10K  [0201]  132.64,108.56 0 top
R17778  10K  [0201]  132.64,109.17 0 top
R17779  10K  [0201]  132.64,109.78 0 top
R17780  10K  [0201]  132.64,110.39 0 top
R17781  10K  [0201]  132.64,111 0 top
R17782  10K  [0201]  132.64,111.61 0 top
R17783  10K  [0201]  132.64,112.22 0 top
R17784  10K  [0201]  132.64,112.83 0 top
R17785  10K  [0201]  132.64,113.44 0 top
R17786  10K  [0201]  132.64,114.05 0 top
R17787  10K  [0201]  132.64,114.66 0 top
R17788  10K  [0201]  132.64,115.27 0 top
R17789  10K  [0201]  132.64,115.87 0 top
R17790  10K  [0201]  132.64,116.48 0 top
R17791  10K  [0201]  132.64,117.09 0 top
R17792  10K  [0201]  132.64,117.7 0 top
R17793  10K  [0201]  132.64,118.31 0 top
R17794  10K  [0201]  132.64,118.92 0 top
R17795  10K  [0201]  132.64,119.53 0 top
R17796  10K  [0201]  132.64,120.14 0 top
R17797  10K  [0201]  132.64,120.75 0 top
R17798  10K  [0201]  132.64,121.36 0 top
R17799  10K  [0201]  132.64,121.97 0 top
R17800  10K  [0201]  132.64,122.58 0 top
R17801  10K  [0201]  133.86,1.27 0 top
R17802  10K  [0201]  133.86,1.88 0 top
R17803  10K  [0201]  133.86,2.49 0 top
R17804  10K  [0201]  133.86,3.1 0 top
R17805  10K  [0201]  133.86,3.71 0 top
R17806  10K  [0201]  133.86,4.32 0 top
R17807  10K  [0201]  133.86,4.93 0 top
R17808  10K  [0201]  133.86,5.54 0 top
R17809  10K  [0201]  133.86,6.15 0 top
R17810  10K  [0201]  133.86,6.76 0 top
R17811  10K  [0201]  133.86,7.37 0 top
R17812  10K  [0201]  133.86,7.98 0 top
R17813  10K  [0201]  133.86,8.59 0 top
R17814  10K  [0201]  133.86,9.19 0 top
R17815  10K  [0201]  133.86,9.8 0 top
R17816  10K  [0201]  133.86,10.41 0 top
R17817  10K  [0201]  133.86,11.02 0 top
R17818  10K  [0201]  133.86,11.63 0 top
R17819  10K  [0201]  133.86,12.24 0 top
R17820  10K  [0201]  133.86,12.85 0 top
R17821  10K  [0201]  133.86,13.46 0 top
R17822  10K  [0201]  133.86,14.07 0 top
R17823  10K  [0201]  133.86,14.68 0 top
R17824  10K  [0201]  133.86,15.29 0 top
R17825  10K  [0201]  133.86,15.9 0 top
R17826  10K  [0201]  133.86,16.51 0 top
R17827  10K  [0201]  133.86,17.12 0 top
R17828  10K  [0201]  133.86,17.73 0 top
R17829  10K  [0201]  133.86,18.34 0 top
R17830  10K  [0201]  133.86,18.95 0 top
R17831  10K  [0201]  133.86,19.56 0 top
R17832  10K  [0201]  133.86,20.17 0 top
R17833  10K  [0201]  133.86,20.78 0 top
R17834  10K  [0201]  133.86,21.39 0 top
R17835  10K  [0201]  133.86,22 0 top
R17836  10K  [0201]  133.86,22.61 0 top
R17837  10K  [0201]  133.86,23.22 0 top
R17838  10K  [0201]  133.86,23.83 0 top
R17839  10K  [0201]  133.86,24.43 0 top
R17840  10K  [0201]  133.86,25.04 0 top
R17841  10K  [0201]  133.86,25.65 0 top
R17842  10K  [0201]  133.86,26.26 0 top
R17843  10K  [0201]  133.86,26.87 0 top
R17844  10K  [0201]  133.86,27.48 0 top
R17845  10K  [0201]  133.86,28.09 0 top
R17846  10K  [0201]  133.86,28.7 0 top
R17847  10K  [0201]  133.86,29.31 0 top
R17848  10K  [0201]  133.86,29.92 0 top
R17849  10K  [0201]  133.86,30.53 0 top
R17850  10K  [0201]  133.86,31.14 0 top
R17851  10K  [0201]  133.86,31.75 0 top
R17852  10K  [0201]  133.86,32.36 0 top
R17853  10K  [0201]  133.86,32.97 0 top
R17854  10K  [0201]  133.86,33.58 0 top
R17855  10K  [0201]  133.86,34.19 0 top
R17856  10K  [0201]  133.86,34.8 0 top
R17857  10K  [0201]  133.86,35.41 0 top
R17858  10K  [0201]  133.86,36.02 0 top
R17859  10K  [0201]  133.86,36.63 0 top
R17860  10K  [0201]  133.86,37.24 0 top
R17861  10K  [0201]  133.86,37.85 0 top
R17862  10K  [0201]  133.86,38.46 0 top
R17863  10K  [0201]  133.86,39.07 0 top
R17864  10K  [0201]  133.86,39.67 0 top
R17865  10K  [0201]  133.86,40.28 0 top
R17866  10K  [0201]  133.86,40.89 0 top
R17867  10K  [0201]  133.86,41.5 0 top
R17868  10K  [0201]  133.86,42.11 0 top
R17869  10K  [0201]  133.86,42.72 0 top
R17870  10K  [0201]  133.86,43.33 0 top
R17871  10K  [0201]  133.86,43.94 0 top
R17872  10K  [0201]  133.86,44.55 0 top
R17873  10K  [0201]  133.86,45.16 0 top
R17874  10K  [0201]  133.86,45.77 0 top
R17875  10K  [0201]  133.86,46.38 0 top
R17876  10K  [0201]  133.86,46.99 0 top
R17877  10K  [0201]  133.86,47.6 0 top
R17878  10K  [0201]  133.86,48.21 0 top
R17879  10K  [0201]  133.86,48.82 0 top
R17880  10K  [0201]  133.86,49.43 0 top
R17881  10K  [0201]  133.86,50.04 0 top
R17882  10K  [0201]  133.86,50.65 0 top
R17883  10K  [0201]  133.86,51.26 0 top
R17884  10K  [0201]  133.86,51.87 0 top
R17885  10K  [0201]  133.86,52.48 0 top
R17886  10K  [0201]  133.86,53.09 0 top
R17887  10K  [0201]  133.86,53.7 0 top
R17888  10K  [0201]  133.86,54.31 0 top
R17889  10K  [0201]  133.86,54.91 0 top
R17890  10K  [0201]  133.86,55.52 0 top
R17891  10K  [0201]  133.86,56.13 0 top
R17892  10K  [0201]  133.86,56.74 0 top
R17893  10K  [0201]  133.86,57.35 0 top
R17894  10K  [0201]  133.86,57.96 0 top
R17895  10K  [0201]  133.86,58.57 0 top
R17896  10K  [0201]  133.86,59.18 0 top
R17897  10K  [0201]  133.86,59.79 0 top
R17898  10K  [0201]  133.86,60.4 0 top
R17899  10K  [0201]  133.86,61.01 0 top
R17900  10K  [0201]  133.86,61.62 0 top
R17901  10K  [0201]  133.86,62.23 0 top
R17902  10K  [0201]  133.86,62.84 0 top
R17903  10K  [0201]  133.86,63.45 0 top
R17904  10K  [0201]  133.86,64.06 0 top
R17905  10K  [0201]  133.86,64.67 0 top
R17906  10K  [0201]  133.86,65.28 0 top
R17907  10K  [0201]  133.86,65.89 0 top
R17908  10K  [0201]  133.86,66.5 0 top
R17909  10K  [0201]  133.86,67.11 0 top
R17910  10K  [0201]  133.86,67.72 0 top
R17911  10K  [0201]  133.86,68.33 0 top
R17912  10K  [0201]  133.86,68.94 0 top
R17913  10K  [0201]  133.86,69.55 0 top
R17914  10K  [0201]  133.86,70.15 0 top
R17915  10K  [0201]  133.86,70.76 0 top
R17916  10K  [0201]  133.86,71.37 0 top
R17917  10K  [0201]  133.86,71.98 0 top
R17918  10K  [0201]  133.86,72.59 0 top
R17919  10K  [0201]  133.86,73.2 0 top
R17920  10K  [0201]  133.86,73.81 0 top
R17921  10K  [0201]  133.86,74.42 0 top
R17922  10K  [0201]  133.86,75.03 0 top
R17923  10K  [0201]  133.86,75.64 0 top
R17924  10K  [0201]  133.86,76.25 0 top
R17925  10K  [0201]  133.86,76.86 0 top
R17926  10K  [0201]  133.86,77.47 0 top
R17927  10K  [0201]  133.86,78.08 0 top
R17928  10K  [0201]  133.86,78.69 0 top
R17929  10K  [0201]  133.86,79.3 0 top
R17930  10K  [0201]  133.86,79.91 0 top
R17931  10K  [0201]  133.86,80.52 0 top
R17932  10K  [0201]  133.86,81.13 0 top
R17933  10K  [0201]  133.86,81.74 0 top
R17934  10K  [0201]  133.86,82.35 0 top
R17935  10K  [0201]  133.86,82.96 0 top
R17936  10K  [0201]  133.86,83.57 0 top
R17937  10K  [0201]  133.86,84.18 0 top
R17938  10K  [0201]  133.86,84.79 0 top
R17939  10K  [0201]  133.86,85.39 0 top
R17940  10K  [0201]  133.86,86 0 top
R17941  10K  [0201]  133.86,86.61 0 top
R17942  10K  [0201]  133.86,87.22 0 top
R17943  10K  [0201]  133.86,87.83 0 top
R17944  10K  [0201]  133.86,88.44 0 top
R17945  10K  [0201]  133.86,89.05 0 top
R17946  10K  [0201]  133.86,89.66 0 top
R17947  10K  [0201]  133.86,90.27 0 top
R17948  10K  [0201]  133.86,90.88 0 top
R17949  10K  [0201]  133.86,91.49 0 top
R17950  10K  [0201]  133.86,92.1 0 top
R17951  10K  [0201]  133.86,92.71 0 top
R17952  10K  [0201]  133.86,93.32 0 top
R17953  10K  [0201]  133.86,93.93 0 top
R17954  10K  [0201]  133.86,94.54 0 top
R17955  10K  [0201]  133.86,95.15 0 top
R17956  10K  [0201]  133.86,95.76 0 top
R17957  10K  [0201]  133.86,96.37 0 top
R17958  10K  [0201]  133.86,96.98 0 top
R17959  10K  [0201]  133.86,97.59 0 top
R17960  10K  [0201]  133.86,98.2 0 top
R17961  10K  [0201]  133.86,98.81 0 top
R17962  10K  [0201]  133.86,99.42 0 top
R17963  10K  [0201]  133.86,100.03 0 top
R17964  10K  [0201]  133.86,100.63 0 top
R17965  10K  [0201]  133.86,101.24 0 top
R17966  10K  [0201]  133.86,101.85 0 top
R17967  10K  [0201]  133.86,102.46 0 top
R17968  10K  [0201]  133.86,103.07 0 top
R17969  10K  [0201]  133.86,103.68 0 top
R17970  10K  [0201]  133.86,104.29 0 top
R17971  10K  [0201]  133.86,104.9 0 top
R17972  10K  [0201]  133.86,105.51 0 top
R17973  10K  [0201]  133.86,106.12 0 top
R17974  10K  [0201]  133.86,106.73 0 top
R17975  10K  [0201]  133.86,107.34 0 top
R17976  10K  [0201]  133.86,107.95 0 top
R17977  10K  [0201]  133.86,108.56 0 top
R17978  10K  [0201]  133.86,109.17 0 top
R17979  10K  [0201]  133.86,109.78 0 top
R17980  10K  [0201]  133.86,110.39 0 top
R17981  10K  [0201]  133.86,111 0 top
R17982  10K  [0201]  133.86,111.61 0 top
R17983  10K  [0201]  133.86,112.22 0 top
R17984  10K  [0201]  133.86,112.83 0 top
R17985  10K  [0201]  133.86,113.44 0 top
R17986  10K  [0201]  133.86,114.05 0 top
R17987  10K  [0201]  133.86,114.66 0 top
R17988  10K  [0201]  133.86,115.27 0 top
R17989  10K  [0201]  133.86,115.87 0 top
R17990  10K  [0201]  133.86,116.48 0 top
R17991  10K  [0201]  133.86,117.09 0 top
R17992  10K  [0201]  133.86,117.7 0 top